# Altium schematic sheet 0219_GPU GDDR6 CHANNELS.SchDoc
size 848 x 558 mm
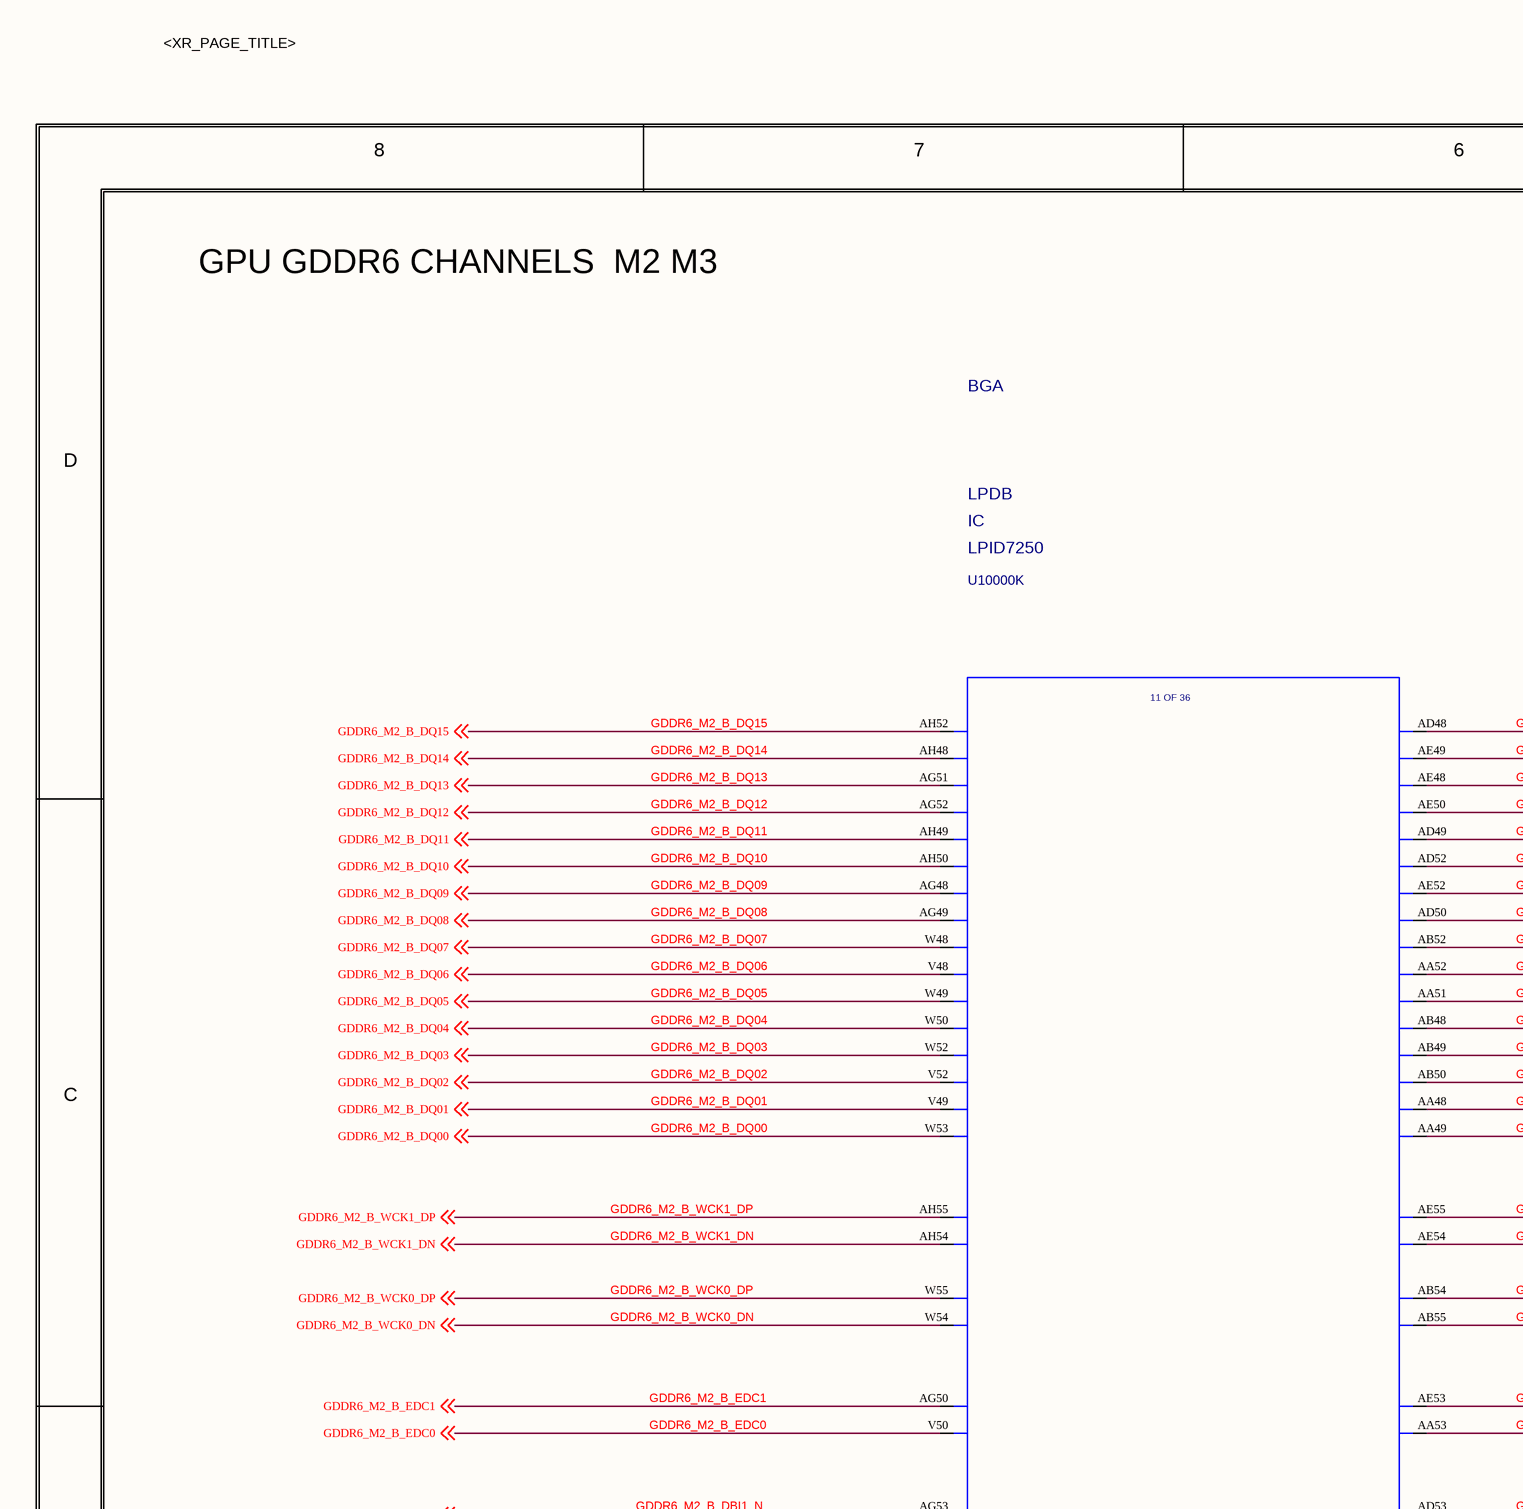
[diagram p0: 0219_GPU GDDR6 CHANNELS.SchDoc, top left]
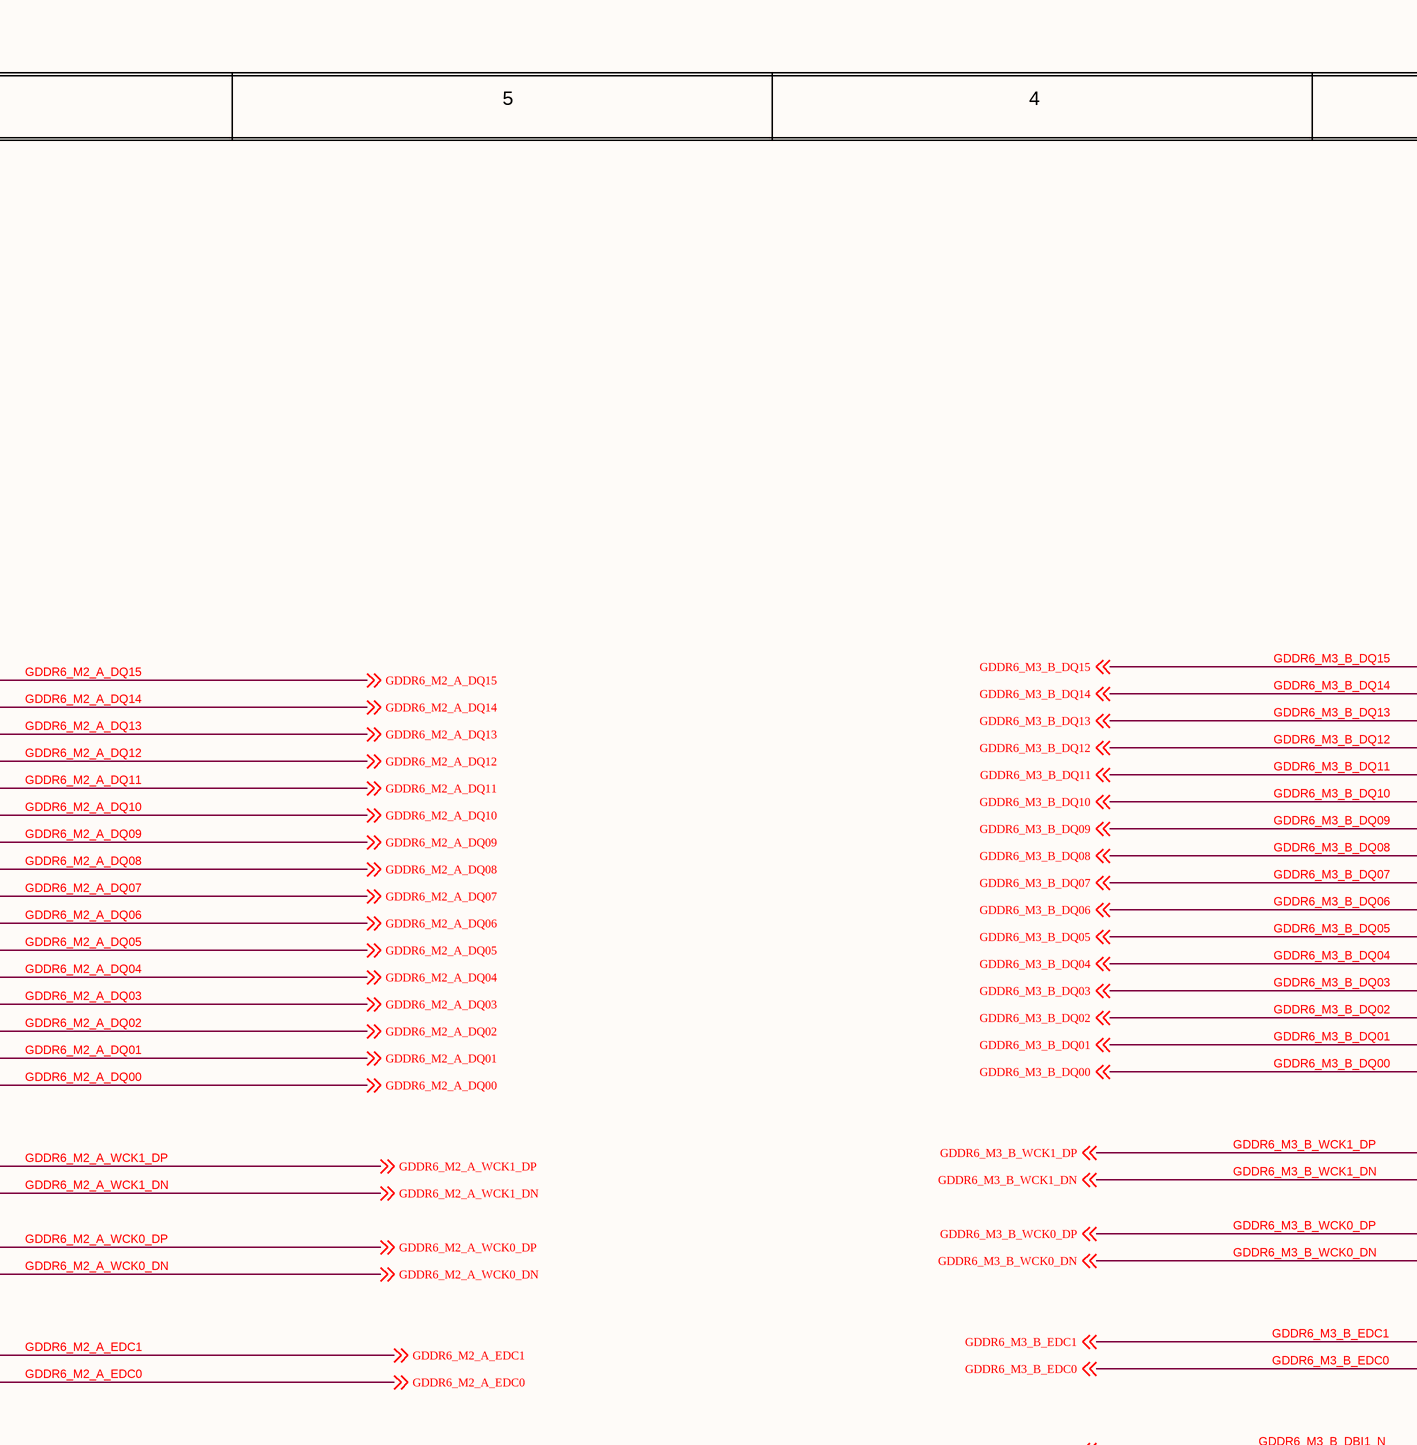
[diagram p1: 0219_GPU GDDR6 CHANNELS.SchDoc, top middle]
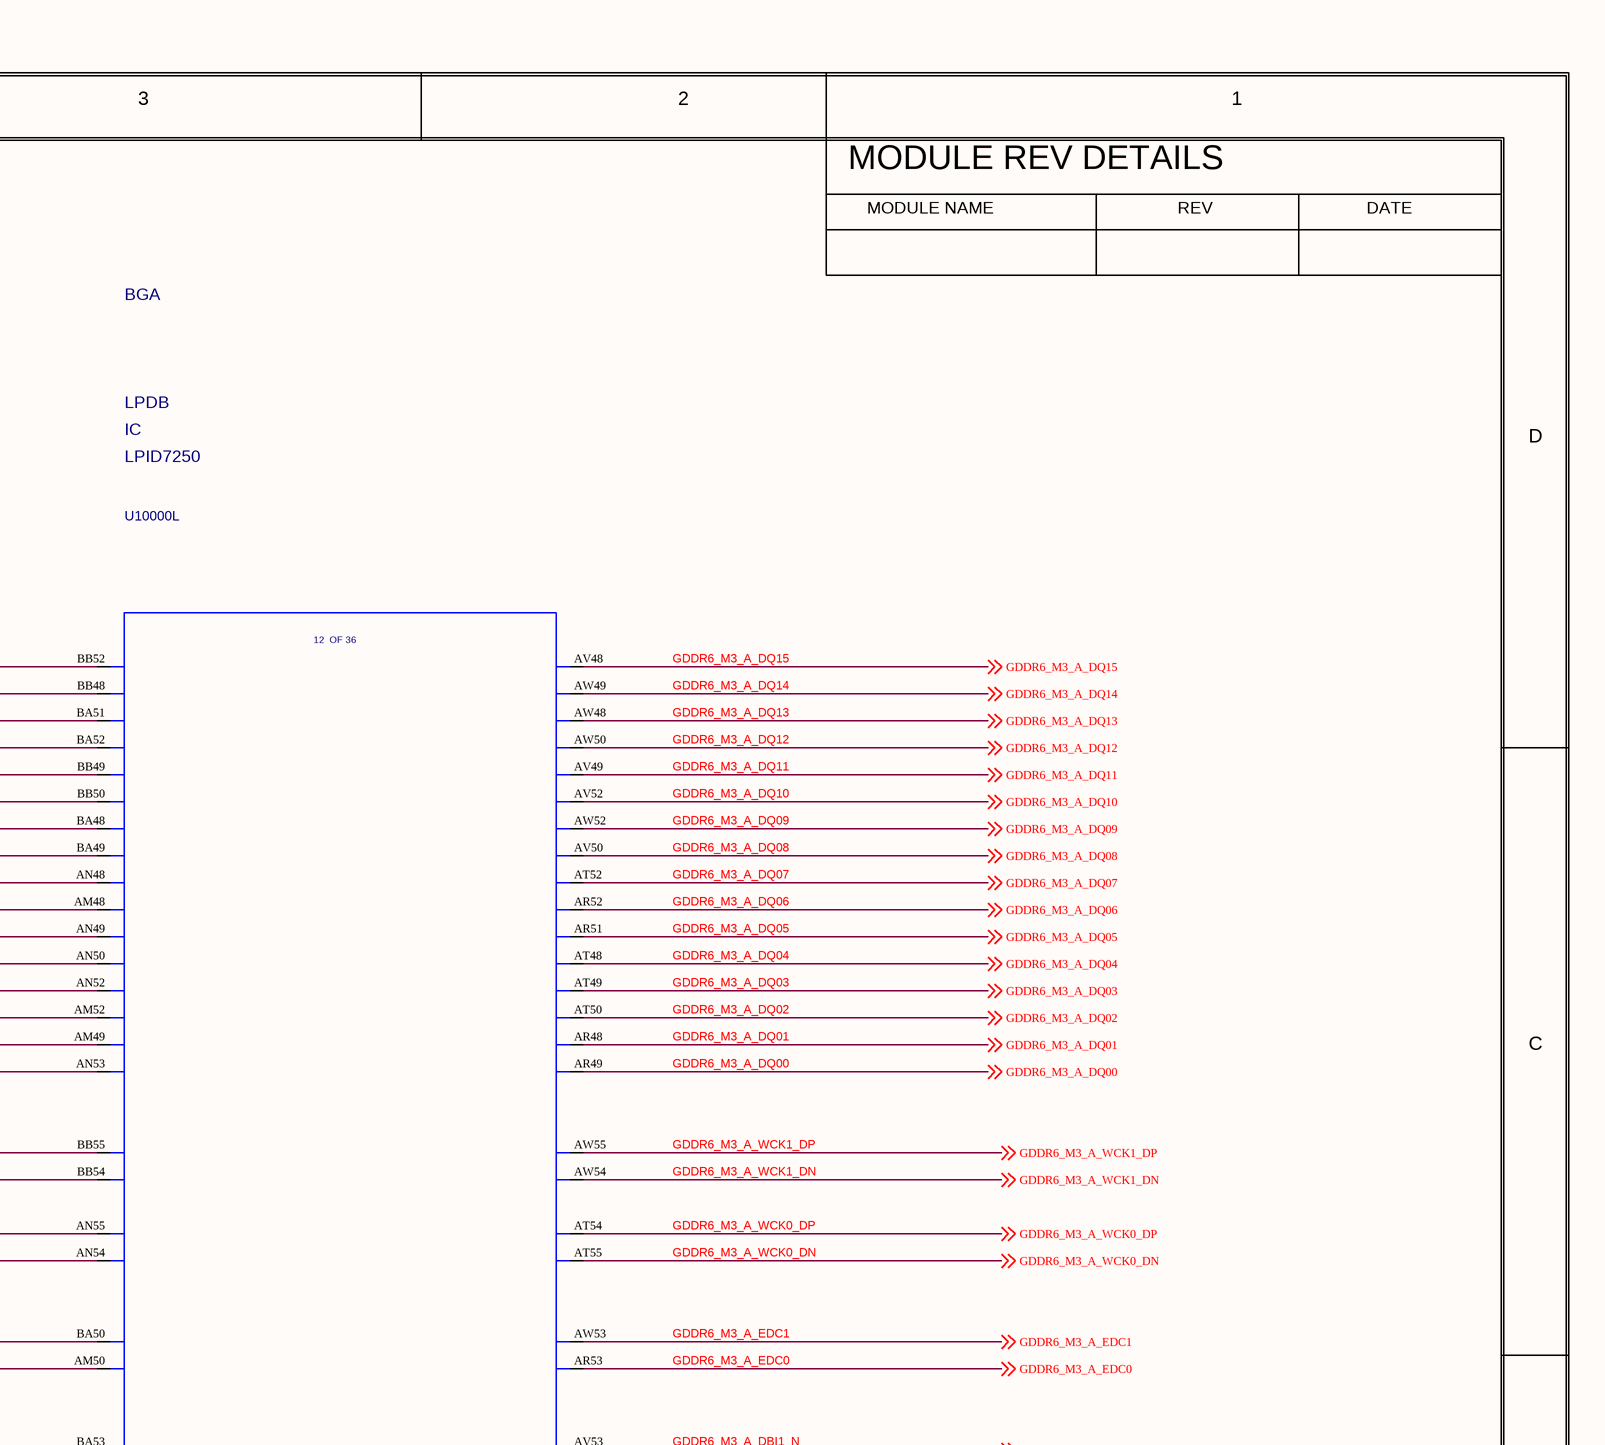
[diagram p2: 0219_GPU GDDR6 CHANNELS.SchDoc, top right]
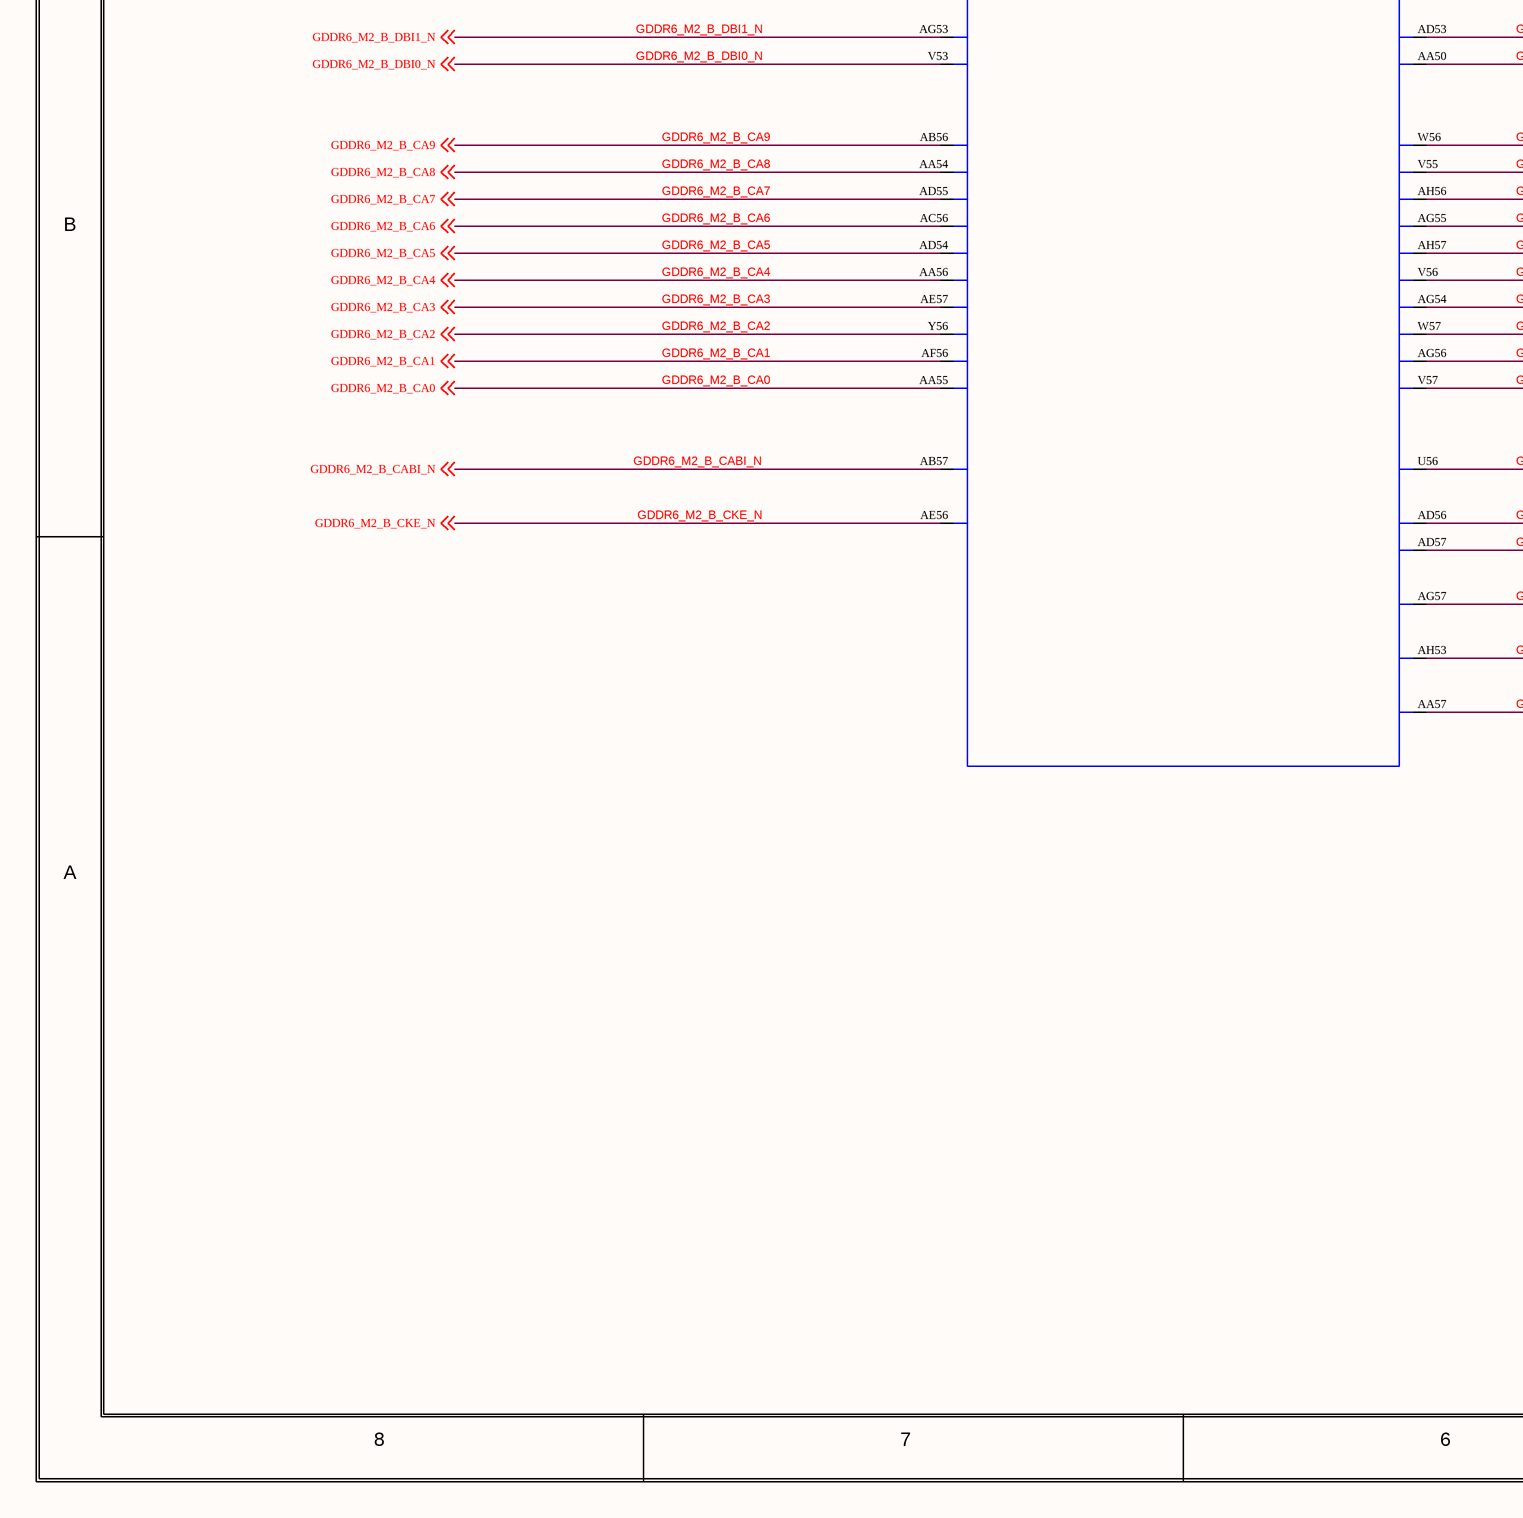
[diagram p3: 0219_GPU GDDR6 CHANNELS.SchDoc, bottom left]
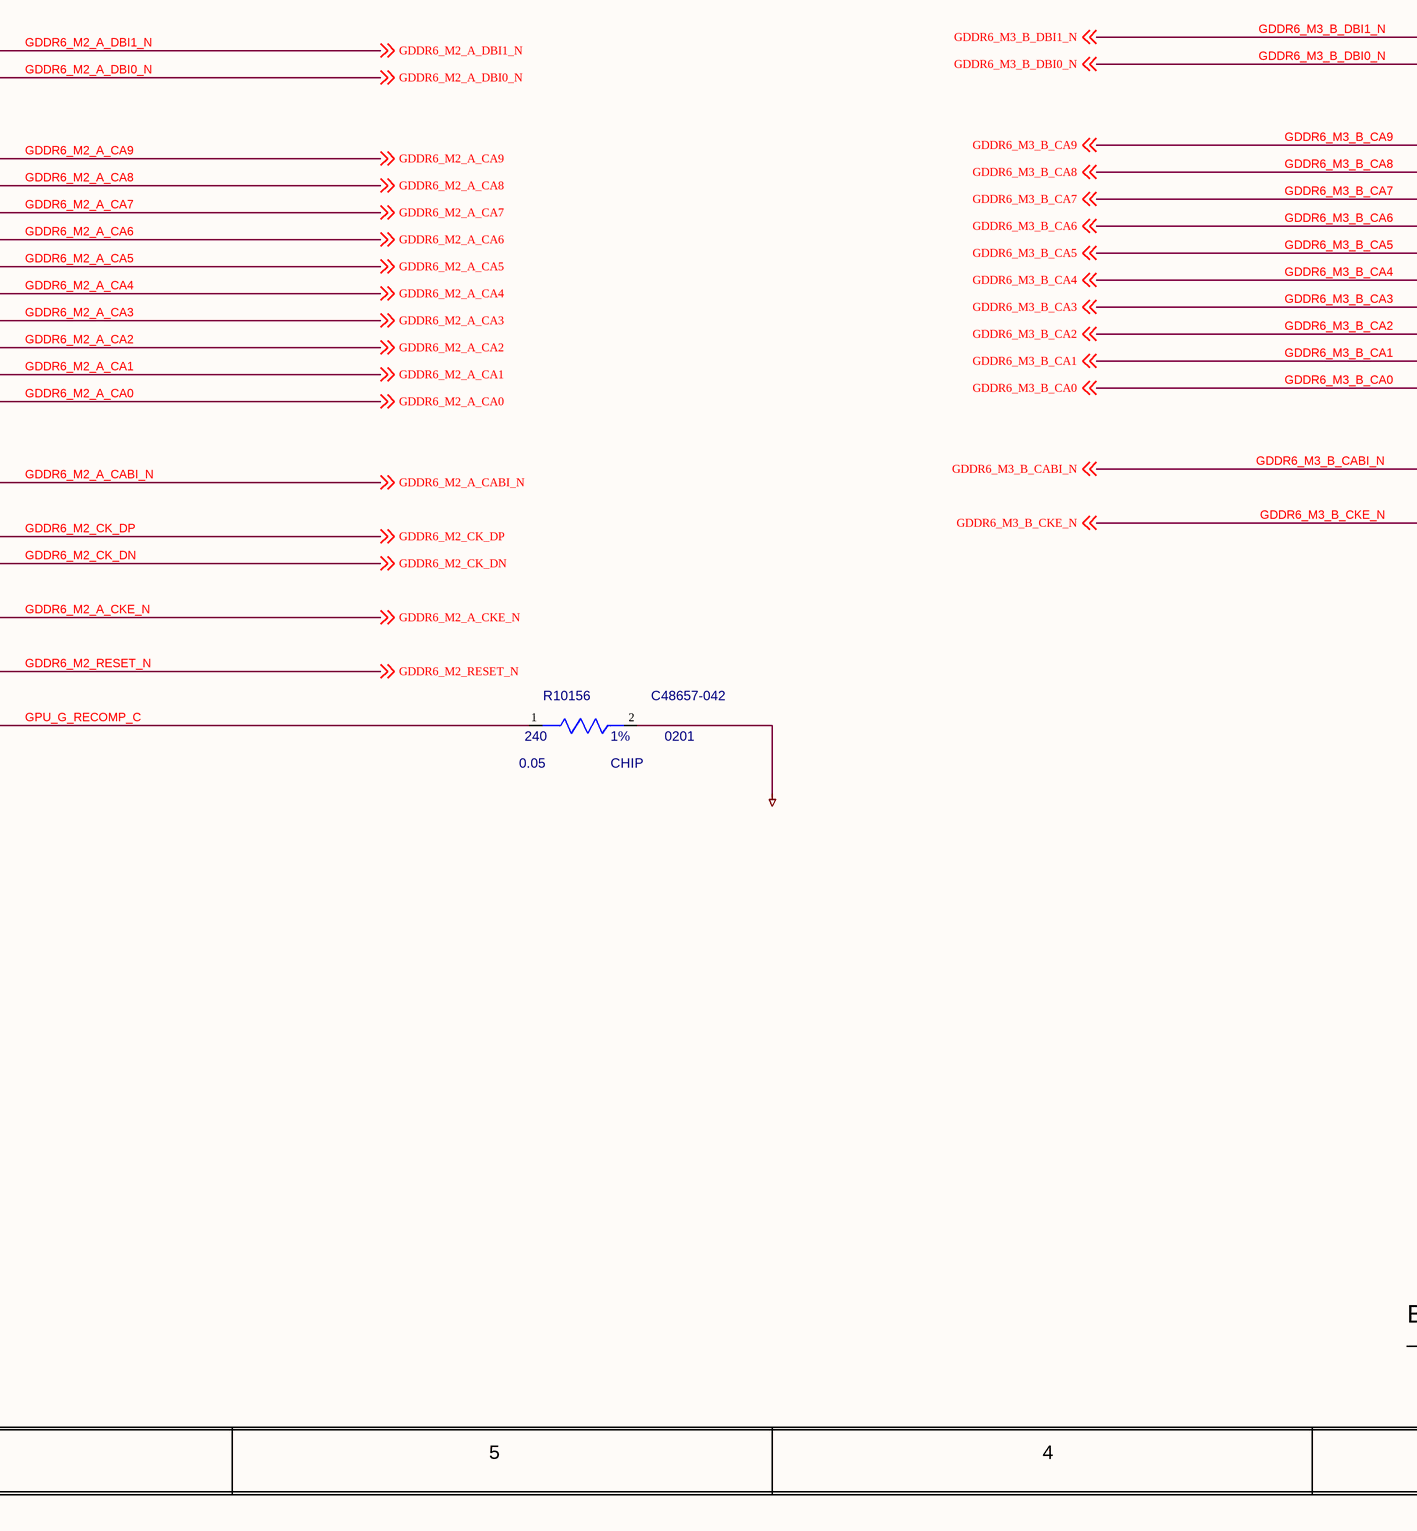
[diagram p4: 0219_GPU GDDR6 CHANNELS.SchDoc, bottom middle]
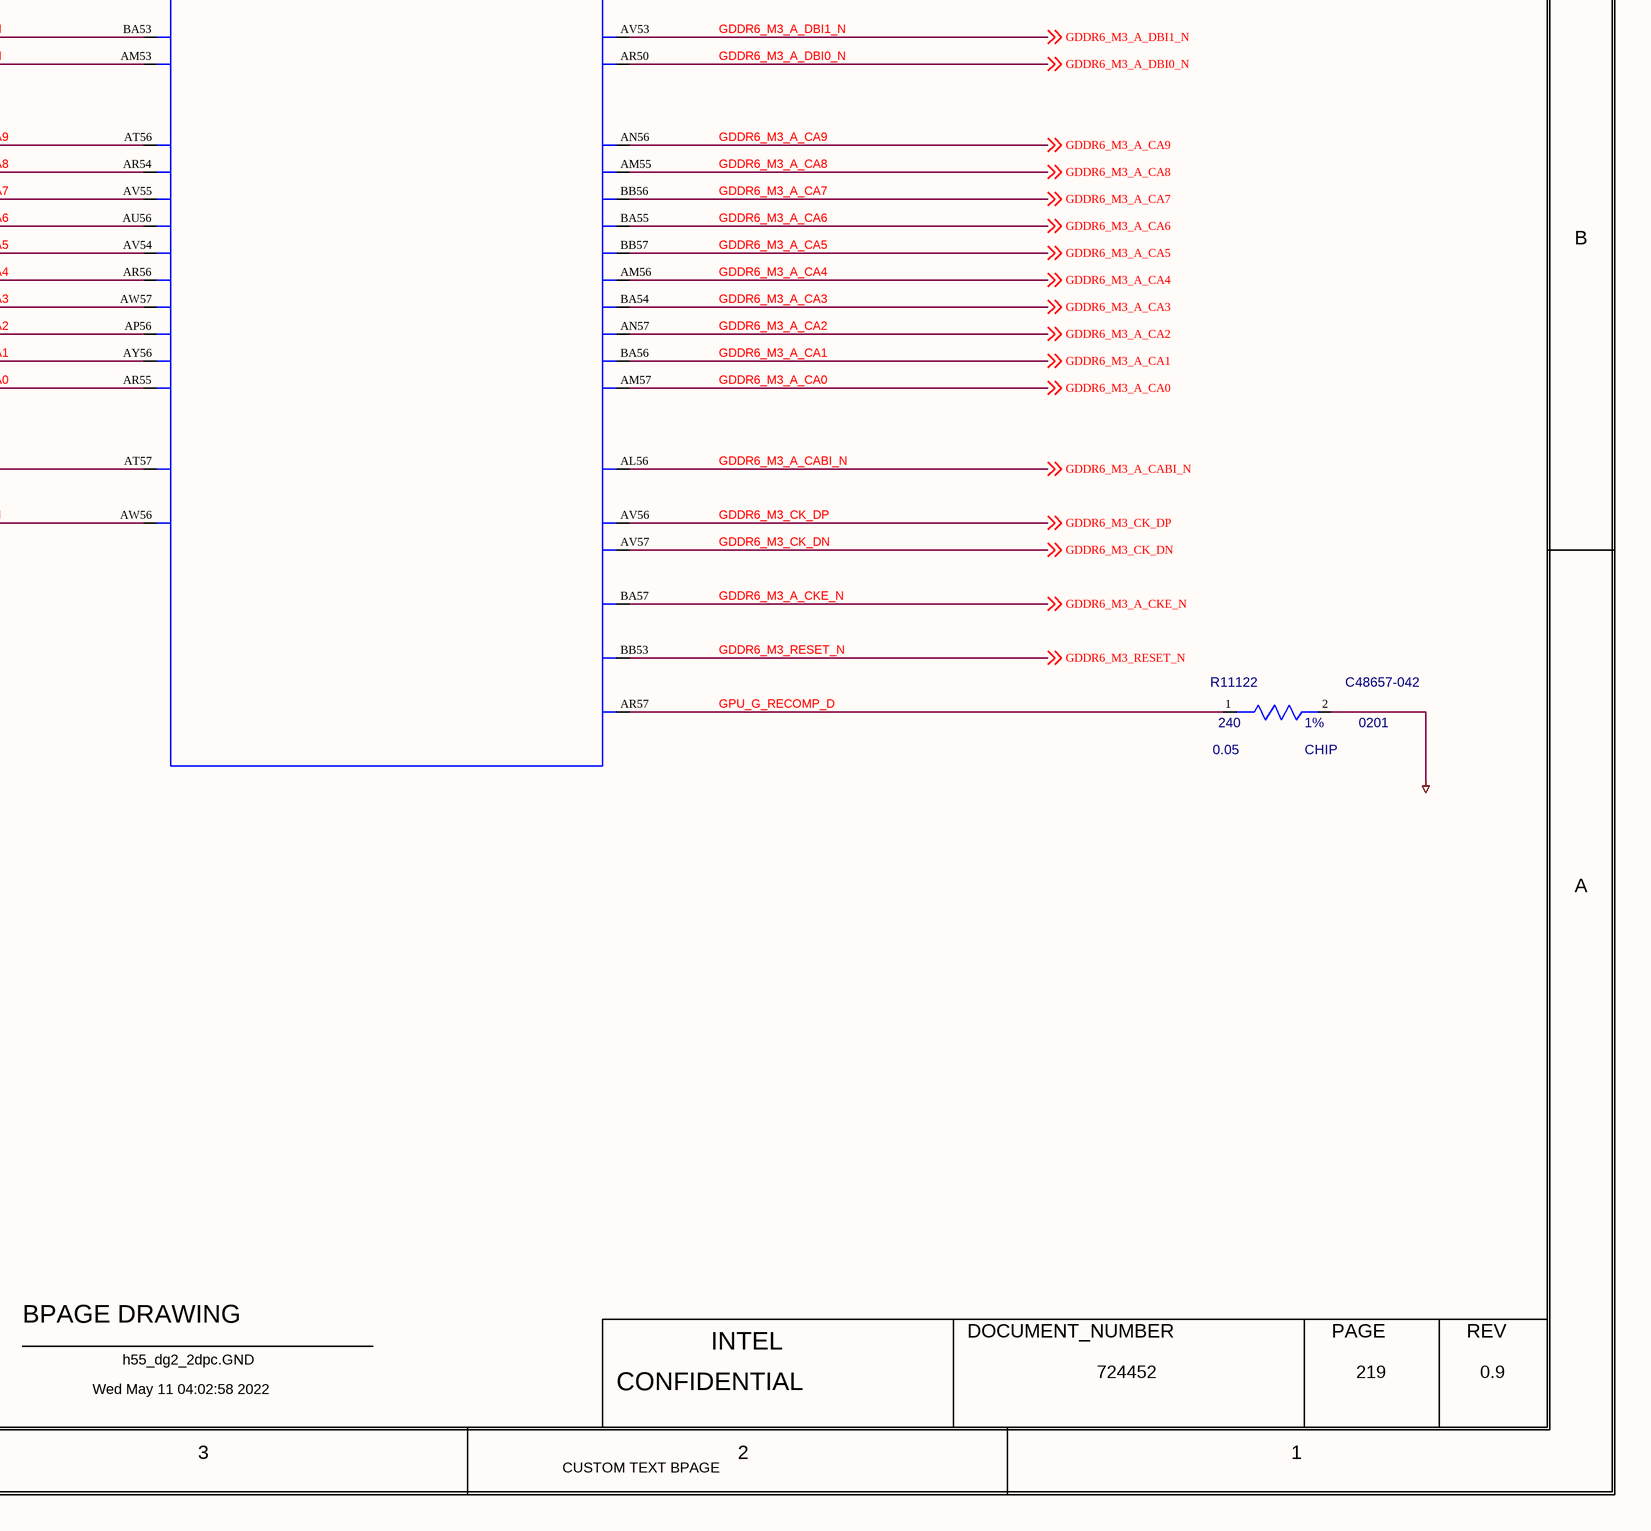
[diagram p5: 0219_GPU GDDR6 CHANNELS.SchDoc, bottom right]

## Parts
R10156  240  MATERIAL: CHIP  PACK_TYPE: 0201  PART_NUMBER: C48657-042  TOLERANCE: 1%  WATTAGE: 0.05  [SMR0201IA]
R11122  240  MATERIAL: CHIP  PACK_TYPE: 0201  PART_NUMBER: C48657-042  TOLERANCE: 1%  WATTAGE: 0.05  [SMR0201IA]
U10000  PART_NUMBER: LPID7250  PACK_TYPE: BGA  MATERIAL: IC  FP_TECH: LPDB  [CLPDB_BGA2660_DG2_SVC_512_LP7250_MA]  (hidden comment: DG2_IP_NB_SKU1_SKU2_SKU3_EXT)  (parts K,L of 36)

## Nets
GND: R10156.2(B) R11122.2(B)
GDDR6_M2_A_CA0: U10000.V57(GDDR_C2_A_CA0) ; off-sheet GDDR6_M2_A_CA0
GDDR6_M2_A_CA1: U10000.AG56(GDDR_C2_A_CA1) ; off-sheet GDDR6_M2_A_CA1
GDDR6_M2_A_CA2: U10000.W57(GDDR_C2_A_CA2) ; off-sheet GDDR6_M2_A_CA2
GDDR6_M2_A_CA3: U10000.AG54(GDDR_C2_A_CA3) ; off-sheet GDDR6_M2_A_CA3
GDDR6_M2_A_CA4: U10000.V56(GDDR_C2_A_CA4) ; off-sheet GDDR6_M2_A_CA4
GDDR6_M2_A_CA5: U10000.AH57(GDDR_C2_A_CA5) ; off-sheet GDDR6_M2_A_CA5
GDDR6_M2_A_CA6: U10000.AG55(GDDR_C2_A_CA6) ; off-sheet GDDR6_M2_A_CA6
GDDR6_M2_A_CA7: U10000.AH56(GDDR_C2_A_CA7) ; off-sheet GDDR6_M2_A_CA7
GDDR6_M2_A_CA8: U10000.V55(GDDR_C2_A_CA8) ; off-sheet GDDR6_M2_A_CA8
GDDR6_M2_A_CA9: U10000.W56(GDDR_C2_A_CA9) ; off-sheet GDDR6_M2_A_CA9
GDDR6_M2_A_CABI_N: U10000.U56(GDDR_C2_A_CABI_N) ; off-sheet GDDR6_M2_A_CABI_N
GDDR6_M2_A_CKE_N: U10000.AG57(GDDR_C2_A_CKE_N) ; off-sheet GDDR6_M2_A_CKE_N
GDDR6_M2_A_DBI0_N: U10000.AA50(GDDR_C2_A_DBI0_N) ; off-sheet GDDR6_M2_A_DBI0_N
GDDR6_M2_A_DBI1_N: U10000.AD53(GDDR_C2_A_DBI1_N) ; off-sheet GDDR6_M2_A_DBI1_N
GDDR6_M2_A_DQ00: U10000.AA49(GDDR_C2_A_DQ0) ; off-sheet GDDR6_M2_A_DQ00
GDDR6_M2_A_DQ01: U10000.AA48(GDDR_C2_A_DQ1) ; off-sheet GDDR6_M2_A_DQ01
GDDR6_M2_A_DQ02: U10000.AB50(GDDR_C2_A_DQ2) ; off-sheet GDDR6_M2_A_DQ02
GDDR6_M2_A_DQ03: U10000.AB49(GDDR_C2_A_DQ3) ; off-sheet GDDR6_M2_A_DQ03
GDDR6_M2_A_DQ04: U10000.AB48(GDDR_C2_A_DQ4) ; off-sheet GDDR6_M2_A_DQ04
GDDR6_M2_A_DQ05: U10000.AA51(GDDR_C2_A_DQ5) ; off-sheet GDDR6_M2_A_DQ05
GDDR6_M2_A_DQ06: U10000.AA52(GDDR_C2_A_DQ6) ; off-sheet GDDR6_M2_A_DQ06
GDDR6_M2_A_DQ07: U10000.AB52(GDDR_C2_A_DQ7) ; off-sheet GDDR6_M2_A_DQ07
GDDR6_M2_A_DQ08: U10000.AD50(GDDR_C2_A_DQ8) ; off-sheet GDDR6_M2_A_DQ08
GDDR6_M2_A_DQ09: U10000.AE52(GDDR_C2_A_DQ9) ; off-sheet GDDR6_M2_A_DQ09
GDDR6_M2_A_DQ10: U10000.AD52(GDDR_C2_A_DQ10) ; off-sheet GDDR6_M2_A_DQ10
GDDR6_M2_A_DQ11: U10000.AD49(GDDR_C2_A_DQ11) ; off-sheet GDDR6_M2_A_DQ11
GDDR6_M2_A_DQ12: U10000.AE50(GDDR_C2_A_DQ12) ; off-sheet GDDR6_M2_A_DQ12
GDDR6_M2_A_DQ13: U10000.AE48(GDDR_C2_A_DQ13) ; off-sheet GDDR6_M2_A_DQ13
GDDR6_M2_A_DQ14: U10000.AE49(GDDR_C2_A_DQ14) ; off-sheet GDDR6_M2_A_DQ14
GDDR6_M2_A_DQ15: U10000.AD48(GDDR_C2_A_DQ15) ; off-sheet GDDR6_M2_A_DQ15
GDDR6_M2_A_EDC0: U10000.AA53(GDDR_C2_A_EDC0) ; off-sheet GDDR6_M2_A_EDC0
GDDR6_M2_A_EDC1: U10000.AE53(GDDR_C2_A_EDC1) ; off-sheet GDDR6_M2_A_EDC1
GDDR6_M2_A_WCK0_DN: U10000.AB55(GDDR_C2_A_WCK0_DN) ; off-sheet GDDR6_M2_A_WCK0_DN
GDDR6_M2_A_WCK0_DP: U10000.AB54(GDDR_C2_A_WCK0_DP) ; off-sheet GDDR6_M2_A_WCK0_DP
GDDR6_M2_A_WCK1_DN: U10000.AE54(GDDR_C2_A_WCK1_DN) ; off-sheet GDDR6_M2_A_WCK1_DN
GDDR6_M2_A_WCK1_DP: U10000.AE55(GDDR_C2_A_WCK1_DP) ; off-sheet GDDR6_M2_A_WCK1_DP
GDDR6_M2_B_CA0: U10000.AA55(GDDR_C2_B_CA0) ; off-sheet GDDR6_M2_B_CA0
GDDR6_M2_B_CA1: U10000.AF56(GDDR_C2_B_CA1) ; off-sheet GDDR6_M2_B_CA1
GDDR6_M2_B_CA2: U10000.Y56(GDDR_C2_B_CA2) ; off-sheet GDDR6_M2_B_CA2
GDDR6_M2_B_CA3: U10000.AE57(GDDR_C2_B_CA3) ; off-sheet GDDR6_M2_B_CA3
GDDR6_M2_B_CA4: U10000.AA56(GDDR_C2_B_CA4) ; off-sheet GDDR6_M2_B_CA4
GDDR6_M2_B_CA5: U10000.AD54(GDDR_C2_B_CA5) ; off-sheet GDDR6_M2_B_CA5
GDDR6_M2_B_CA6: U10000.AC56(GDDR_C2_B_CA6) ; off-sheet GDDR6_M2_B_CA6
GDDR6_M2_B_CA7: U10000.AD55(GDDR_C2_B_CA7) ; off-sheet GDDR6_M2_B_CA7
GDDR6_M2_B_CA8: U10000.AA54(GDDR_C2_B_CA8) ; off-sheet GDDR6_M2_B_CA8
GDDR6_M2_B_CA9: U10000.AB56(GDDR_C2_B_CA9) ; off-sheet GDDR6_M2_B_CA9
GDDR6_M2_B_CABI_N: U10000.AB57(GDDR_C2_B_CABI_N) ; off-sheet GDDR6_M2_B_CABI_N
GDDR6_M2_B_CKE_N: U10000.AE56(GDDR_C2_B_CKE_N) ; off-sheet GDDR6_M2_B_CKE_N
GDDR6_M2_B_DBI0_N: U10000.V53(GDDR_C2_B_DBI0_N) ; off-sheet GDDR6_M2_B_DBI0_N
GDDR6_M2_B_DBI1_N: U10000.AG53(GDDR_C2_B_DBI1_N) ; off-sheet GDDR6_M2_B_DBI1_N
GDDR6_M2_B_DQ00: U10000.W53(GDDR_C2_B_DQ0) ; off-sheet GDDR6_M2_B_DQ00
GDDR6_M2_B_DQ01: U10000.V49(GDDR_C2_B_DQ1) ; off-sheet GDDR6_M2_B_DQ01
GDDR6_M2_B_DQ02: U10000.V52(GDDR_C2_B_DQ2) ; off-sheet GDDR6_M2_B_DQ02
GDDR6_M2_B_DQ03: U10000.W52(GDDR_C2_B_DQ3) ; off-sheet GDDR6_M2_B_DQ03
GDDR6_M2_B_DQ04: U10000.W50(GDDR_C2_B_DQ4) ; off-sheet GDDR6_M2_B_DQ04
GDDR6_M2_B_DQ05: U10000.W49(GDDR_C2_B_DQ5) ; off-sheet GDDR6_M2_B_DQ05
GDDR6_M2_B_DQ06: U10000.V48(GDDR_C2_B_DQ6) ; off-sheet GDDR6_M2_B_DQ06
GDDR6_M2_B_DQ07: U10000.W48(GDDR_C2_B_DQ7) ; off-sheet GDDR6_M2_B_DQ07
GDDR6_M2_B_DQ08: U10000.AG49(GDDR_C2_B_DQ8) ; off-sheet GDDR6_M2_B_DQ08
GDDR6_M2_B_DQ09: U10000.AG48(GDDR_C2_B_DQ9) ; off-sheet GDDR6_M2_B_DQ09
GDDR6_M2_B_DQ10: U10000.AH50(GDDR_C2_B_DQ10) ; off-sheet GDDR6_M2_B_DQ10
GDDR6_M2_B_DQ11: U10000.AH49(GDDR_C2_B_DQ11) ; off-sheet GDDR6_M2_B_DQ11
GDDR6_M2_B_DQ12: U10000.AG52(GDDR_C2_B_DQ12) ; off-sheet GDDR6_M2_B_DQ12
GDDR6_M2_B_DQ13: U10000.AG51(GDDR_C2_B_DQ13) ; off-sheet GDDR6_M2_B_DQ13
GDDR6_M2_B_DQ14: U10000.AH48(GDDR_C2_B_DQ14) ; off-sheet GDDR6_M2_B_DQ14
GDDR6_M2_B_DQ15: U10000.AH52(GDDR_C2_B_DQ15) ; off-sheet GDDR6_M2_B_DQ15
GDDR6_M2_B_EDC0: U10000.V50(GDDR_C2_B_EDC0) ; off-sheet GDDR6_M2_B_EDC0
GDDR6_M2_B_EDC1: U10000.AG50(GDDR_C2_B_EDC1) ; off-sheet GDDR6_M2_B_EDC1
GDDR6_M2_B_WCK0_DN: U10000.W54(GDDR_C2_B_WCK0_DN) ; off-sheet GDDR6_M2_B_WCK0_DN
GDDR6_M2_B_WCK0_DP: U10000.W55(GDDR_C2_B_WCK0_DP) ; off-sheet GDDR6_M2_B_WCK0_DP
GDDR6_M2_B_WCK1_DN: U10000.AH54(GDDR_C2_B_WCK1_DN) ; off-sheet GDDR6_M2_B_WCK1_DN
GDDR6_M2_B_WCK1_DP: U10000.AH55(GDDR_C2_B_WCK1_DP) ; off-sheet GDDR6_M2_B_WCK1_DP
GDDR6_M2_CK_DN: U10000.AD57(GDDR_C2_CK_DN) ; off-sheet GDDR6_M2_CK_DN
GDDR6_M2_CK_DP: U10000.AD56(GDDR_C2_CK_DP) ; off-sheet GDDR6_M2_CK_DP
GDDR6_M2_RESET_N: U10000.AH53(GDDR_C2_RESET_N) ; off-sheet GDDR6_M2_RESET_N
GDDR6_M3_A_CA0: U10000.AM57(GDDR_C3_A_CA0) ; off-sheet GDDR6_M3_A_CA0
GDDR6_M3_A_CA1: U10000.BA56(GDDR_C3_A_CA1) ; off-sheet GDDR6_M3_A_CA1
GDDR6_M3_A_CA2: U10000.AN57(GDDR_C3_A_CA2) ; off-sheet GDDR6_M3_A_CA2
GDDR6_M3_A_CA3: U10000.BA54(GDDR_C3_A_CA3) ; off-sheet GDDR6_M3_A_CA3
GDDR6_M3_A_CA4: U10000.AM56(GDDR_C3_A_CA4) ; off-sheet GDDR6_M3_A_CA4
GDDR6_M3_A_CA5: U10000.BB57(GDDR_C3_A_CA5) ; off-sheet GDDR6_M3_A_CA5
GDDR6_M3_A_CA6: U10000.BA55(GDDR_C3_A_CA6) ; off-sheet GDDR6_M3_A_CA6
GDDR6_M3_A_CA7: U10000.BB56(GDDR_C3_A_CA7) ; off-sheet GDDR6_M3_A_CA7
GDDR6_M3_A_CA8: U10000.AM55(GDDR_C3_A_CA8) ; off-sheet GDDR6_M3_A_CA8
GDDR6_M3_A_CA9: U10000.AN56(GDDR_C3_A_CA9) ; off-sheet GDDR6_M3_A_CA9
GDDR6_M3_A_CABI_N: U10000.AL56(GDDR_C3_A_CABI_N) ; off-sheet GDDR6_M3_A_CABI_N
GDDR6_M3_A_CKE_N: U10000.BA57(GDDR_C3_A_CKE_N) ; off-sheet GDDR6_M3_A_CKE_N
GDDR6_M3_A_DBI0_N: U10000.AR50(GDDR_C3_A_DBI0_N) ; off-sheet GDDR6_M3_A_DBI0_N
GDDR6_M3_A_DBI1_N: U10000.AV53(GDDR_C3_A_DBI1_N) ; off-sheet GDDR6_M3_A_DBI1_N
GDDR6_M3_A_DQ00: U10000.AR49(GDDR_C3_A_DQ0) ; off-sheet GDDR6_M3_A_DQ00
GDDR6_M3_A_DQ01: U10000.AR48(GDDR_C3_A_DQ1) ; off-sheet GDDR6_M3_A_DQ01
GDDR6_M3_A_DQ02: U10000.AT50(GDDR_C3_A_DQ2) ; off-sheet GDDR6_M3_A_DQ02
GDDR6_M3_A_DQ03: U10000.AT49(GDDR_C3_A_DQ3) ; off-sheet GDDR6_M3_A_DQ03
GDDR6_M3_A_DQ04: U10000.AT48(GDDR_C3_A_DQ4) ; off-sheet GDDR6_M3_A_DQ04
GDDR6_M3_A_DQ05: U10000.AR51(GDDR_C3_A_DQ5) ; off-sheet GDDR6_M3_A_DQ05
GDDR6_M3_A_DQ06: U10000.AR52(GDDR_C3_A_DQ6) ; off-sheet GDDR6_M3_A_DQ06
GDDR6_M3_A_DQ07: U10000.AT52(GDDR_C3_A_DQ7) ; off-sheet GDDR6_M3_A_DQ07
GDDR6_M3_A_DQ08: U10000.AV50(GDDR_C3_A_DQ8) ; off-sheet GDDR6_M3_A_DQ08
GDDR6_M3_A_DQ09: U10000.AW52(GDDR_C3_A_DQ9) ; off-sheet GDDR6_M3_A_DQ09
GDDR6_M3_A_DQ10: U10000.AV52(GDDR_C3_A_DQ10) ; off-sheet GDDR6_M3_A_DQ10
GDDR6_M3_A_DQ11: U10000.AV49(GDDR_C3_A_DQ11) ; off-sheet GDDR6_M3_A_DQ11
GDDR6_M3_A_DQ12: U10000.AW50(GDDR_C3_A_DQ12) ; off-sheet GDDR6_M3_A_DQ12
GDDR6_M3_A_DQ13: U10000.AW48(GDDR_C3_A_DQ13) ; off-sheet GDDR6_M3_A_DQ13
GDDR6_M3_A_DQ14: U10000.AW49(GDDR_C3_A_DQ14) ; off-sheet GDDR6_M3_A_DQ14
GDDR6_M3_A_DQ15: U10000.AV48(GDDR_C3_A_DQ15) ; off-sheet GDDR6_M3_A_DQ15
GDDR6_M3_A_EDC0: U10000.AR53(GDDR_C3_A_EDC0) ; off-sheet GDDR6_M3_A_EDC0
GDDR6_M3_A_EDC1: U10000.AW53(GDDR_C3_A_EDC1) ; off-sheet GDDR6_M3_A_EDC1
GDDR6_M3_A_WCK0_DN: U10000.AT55(GDDR_C3_A_WCK0_DN) ; off-sheet GDDR6_M3_A_WCK0_DN
GDDR6_M3_A_WCK0_DP: U10000.AT54(GDDR_C3_A_WCK0_DP) ; off-sheet GDDR6_M3_A_WCK0_DP
GDDR6_M3_A_WCK1_DN: U10000.AW54(GDDR_C3_A_WCK1_DN) ; off-sheet GDDR6_M3_A_WCK1_DN
GDDR6_M3_A_WCK1_DP: U10000.AW55(GDDR_C3_A_WCK1_DP) ; off-sheet GDDR6_M3_A_WCK1_DP
GDDR6_M3_B_CA0: U10000.AR55(GDDR_C3_B_CA0) ; off-sheet GDDR6_M3_B_CA0
GDDR6_M3_B_CA1: U10000.AY56(GDDR_C3_B_CA1) ; off-sheet GDDR6_M3_B_CA1
GDDR6_M3_B_CA2: U10000.AP56(GDDR_C3_B_CA2) ; off-sheet GDDR6_M3_B_CA2
GDDR6_M3_B_CA3: U10000.AW57(GDDR_C3_B_CA3) ; off-sheet GDDR6_M3_B_CA3
GDDR6_M3_B_CA4: U10000.AR56(GDDR_C3_B_CA4) ; off-sheet GDDR6_M3_B_CA4
GDDR6_M3_B_CA5: U10000.AV54(GDDR_C3_B_CA5) ; off-sheet GDDR6_M3_B_CA5
GDDR6_M3_B_CA6: U10000.AU56(GDDR_C3_B_CA6) ; off-sheet GDDR6_M3_B_CA6
GDDR6_M3_B_CA7: U10000.AV55(GDDR_C3_B_CA7) ; off-sheet GDDR6_M3_B_CA7
GDDR6_M3_B_CA8: U10000.AR54(GDDR_C3_B_CA8) ; off-sheet GDDR6_M3_B_CA8
GDDR6_M3_B_CA9: U10000.AT56(GDDR_C3_B_CA9) ; off-sheet GDDR6_M3_B_CA9
GDDR6_M3_B_CABI_N: U10000.AT57(GDDR_C3_B_CABI_N) ; off-sheet GDDR6_M3_B_CABI_N
GDDR6_M3_B_CKE_N: U10000.AW56(GDDR_C3_B_CKE_N) ; off-sheet GDDR6_M3_B_CKE_N
GDDR6_M3_B_DBI0_N: U10000.AM53(GDDR_C3_B_DBI0_N) ; off-sheet GDDR6_M3_B_DBI0_N
GDDR6_M3_B_DBI1_N: U10000.BA53(GDDR_C3_B_DBI1_N) ; off-sheet GDDR6_M3_B_DBI1_N
GDDR6_M3_B_DQ00: U10000.AN53(GDDR_C3_B_DQ0) ; off-sheet GDDR6_M3_B_DQ00
GDDR6_M3_B_DQ01: U10000.AM49(GDDR_C3_B_DQ1) ; off-sheet GDDR6_M3_B_DQ01
GDDR6_M3_B_DQ02: U10000.AM52(GDDR_C3_B_DQ2) ; off-sheet GDDR6_M3_B_DQ02
GDDR6_M3_B_DQ03: U10000.AN52(GDDR_C3_B_DQ3) ; off-sheet GDDR6_M3_B_DQ03
GDDR6_M3_B_DQ04: U10000.AN50(GDDR_C3_B_DQ4) ; off-sheet GDDR6_M3_B_DQ04
GDDR6_M3_B_DQ05: U10000.AN49(GDDR_C3_B_DQ5) ; off-sheet GDDR6_M3_B_DQ05
GDDR6_M3_B_DQ06: U10000.AM48(GDDR_C3_B_DQ6) ; off-sheet GDDR6_M3_B_DQ06
GDDR6_M3_B_DQ07: U10000.AN48(GDDR_C3_B_DQ7) ; off-sheet GDDR6_M3_B_DQ07
GDDR6_M3_B_DQ08: U10000.BA49(GDDR_C3_B_DQ8) ; off-sheet GDDR6_M3_B_DQ08
GDDR6_M3_B_DQ09: U10000.BA48(GDDR_C3_B_DQ9) ; off-sheet GDDR6_M3_B_DQ09
GDDR6_M3_B_DQ10: U10000.BB50(GDDR_C3_B_DQ10) ; off-sheet GDDR6_M3_B_DQ10
GDDR6_M3_B_DQ11: U10000.BB49(GDDR_C3_B_DQ11) ; off-sheet GDDR6_M3_B_DQ11
GDDR6_M3_B_DQ12: U10000.BA52(GDDR_C3_B_DQ12) ; off-sheet GDDR6_M3_B_DQ12
GDDR6_M3_B_DQ13: U10000.BA51(GDDR_C3_B_DQ13) ; off-sheet GDDR6_M3_B_DQ13
GDDR6_M3_B_DQ14: U10000.BB48(GDDR_C3_B_DQ14) ; off-sheet GDDR6_M3_B_DQ14
GDDR6_M3_B_DQ15: U10000.BB52(GDDR_C3_B_DQ15) ; off-sheet GDDR6_M3_B_DQ15
GDDR6_M3_B_EDC0: U10000.AM50(GDDR_C3_B_EDC0) ; off-sheet GDDR6_M3_B_EDC0
GDDR6_M3_B_EDC1: U10000.BA50(GDDR_C3_B_EDC1) ; off-sheet GDDR6_M3_B_EDC1
GDDR6_M3_B_WCK0_DN: U10000.AN54(GDDR_C3_B_WCK0_DN) ; off-sheet GDDR6_M3_B_WCK0_DN
GDDR6_M3_B_WCK0_DP: U10000.AN55(GDDR_C3_B_WCK0_DP) ; off-sheet GDDR6_M3_B_WCK0_DP
GDDR6_M3_B_WCK1_DN: U10000.BB54(GDDR_C3_B_WCK1_DN) ; off-sheet GDDR6_M3_B_WCK1_DN
GDDR6_M3_B_WCK1_DP: U10000.BB55(GDDR_C3_B_WCK1_DP) ; off-sheet GDDR6_M3_B_WCK1_DP
GDDR6_M3_CK_DN: U10000.AV57(GDDR_C3_CK_DN) ; off-sheet GDDR6_M3_CK_DN
GDDR6_M3_CK_DP: U10000.AV56(GDDR_C3_CK_DP) ; off-sheet GDDR6_M3_CK_DP
GDDR6_M3_RESET_N: U10000.BB53(GDDR_C3_RESET_N) ; off-sheet GDDR6_M3_RESET_N
GPU_G_RECOMP_C: R10156.1(A) U10000.AA57(GDDR_RCOMP_C)
GPU_G_RECOMP_D: R11122.1(A) U10000.AR57(GDDR_RCOMP_D)

## Notes on the sheet
- <XR_PAGE_TITLE>
- 8
- 7
- 6
- 5
- 4
- 3
- 2
- 1
- MODULE REV DETAILS
- GPU GDDR6 CHANNELS  M2 M3
- MODULE NAME
- REV
- DATE
- D
- C
- B
- A
- BPAGE DRAWING
- INTEL
- DOCUMENT_NUMBER
- PAGE
- Wed May 11 04:02:58 2022
- h55_dg2_2dpc.GND
- CONFIDENTIAL
- 724452
- 219
- 0.9
- CUSTOM TEXT BPAGE
- (in symbol DG2_IP_NB_SKU1_SKU2_SKU3_EXT, part K) 11 OF 36
- (in symbol DG2_IP_NB_SKU1_SKU2_SKU3_EXT, part L) 12  OF 36

## Library data of the parts
R10156 = RES#1: CHIPS_PART_NAME: RES; CDS_PHYS_PART_NAME: RES_0201-C48657-042,CHIP,240,1%,0.05,LPDB,GENERIC; OriginalSymbolOrigin: (-75,25); XY: (5300,3250); VER: 1; ROT: 0; PHYS_PAGE: 219; LOCATION: R10156; IP: GENERIC; FP_TECH: LPDB; DRAWING: @RVP1_ADL_SB_ADP_S_DDR5_SODIMM_2DPC_LIB.H55_DG2_2DPC(SCH_1):PAGE390; CDS_LIB: discrete; PCB Footprint: SMR0201IA; CDS_PART_NAME: RES_0201-C48657-042,CHIP,240,1%,0.05,LPDB,GENERIC; CDS_LOCATION: R10156
R11122 = RES#1: CHIPS_PART_NAME: RES; CDS_PHYS_PART_NAME: RES_0201-C48657-042,CHIP,240,1%,0.05,LPDB,GENERIC; OriginalSymbolOrigin: (-75,25); XY: (9150,3275); VER: 1; ROT: 0; PHYS_PAGE: 219; LOCATION: R11122; IP: GENERIC; FP_TECH: LPDB; DRAWING: @RVP1_ADL_SB_ADP_S_DDR5_SODIMM_2DPC_LIB.H55_DG2_2DPC(SCH_1):PAGE390; CDS_LIB: discrete; PCB Footprint: SMR0201IA; CDS_PART_NAME: RES_0201-C48657-042,CHIP,240,1%,0.05,LPDB,GENERIC; CDS_LOCATION: R11122
U10000 = DG2_IP_NB_SKU1_SKU2_SKU3_EXT: MANUF: INTEL CORP; CDS_PHYS_PART_NAME: DG2_IP_NB_SKU1_SKU2_SKU3_EXT_BGA-LPID7250,IC,DG2_IP_NB_SKU1_SKUA; CDS_LMAN_SYM_OUTLINE: -300,850,300,-800; OriginalSymbolOrigin: (-325,850); CaptureCellPackProp: DG2_IP_NB_SKU1_SKU2_SKU3_EXTK; XY: (3650,4600); VER: 11; ROT: 0; PHYS_PAGE: 219; MFG_PN: NONE; LOCATION: U10000; DRAWING: @RVP1_ADL_SB_ADP_S_DDR5_SODIMM_2DPC_LIB.H55_DG2_2DPC(SCH_1):PAGE390; CDS_LIB: rvp1_adl_sb_adp_s_ddr5_sodimm_2dpc_lib; BMAP_REV: 1.0; PCB Footprint: CLPDB_BGA2660_DG2_SVC_512_LP7250_MA; SEC_TYPE: BGA; CHIPS_PART_NAME: DG2_IP_NB_SKU1_SKU2_SKU3_EXT; CDS_PART_NAME: DG2_IP_NB_SKU1_SKU2_SKU3_EXT_BGA-LPID7250,IC,DG2_IP_NB_SKU1_SKUA; CDS_LOCATION: U10000